# EasyEDA Pro project Dart25-有控镖航电系统.eprj, board PCB2
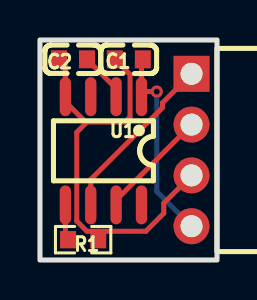
[diagram p8: board, top side]
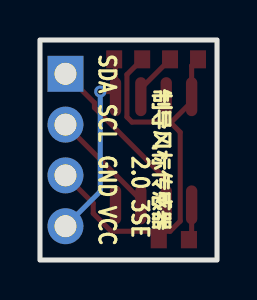
[diagram p9: board, bottom side, seen from below]

Outline 8.86 x 11 mm; copper layers: Top Layer, Bottom Layer. Coordinates in mm from the lower left corner of the outline.
Outline path: rectangle 0,11 8.86,0
Stack: Top Layer 0.035mm / Dielectric1 1.51mm FR4 er 4.5 / Bottom Layer 0.035mm

## Design rules (mm)
template: JLCPCB Capability(Two Layers Board)
spacing copperThickness1oz (default): track to track 0.102, other pairs 0.152 to 0.3
spacing copperThickness2oz: track to track 0.203, other pairs 0.152 to 0.3
track width copperThickness1oz (default): min 0.127, default 0.254, max 2.54
track width copperThickness2oz: min 0.203, default 0.254, max 2.54
differential pair differentialPair (default): width min 0.127, default 0.254, max 2.54; gap min 0.152, default 0.152
via viaSize (default): diameter min 0.5, default 0.61, max 10; hole min 0.3, default 0.305, max 6.3

## Placement (name value [footprint] x y rotation side)
C1  100nF  [C0603]  4.44 10.03 0 top
C2  1uF  [C0603]  1.65 10.03 0 top
R1  10kΩ  [R0603]  2.16 1.02 180 top
U1  AS5600-ASOM  [soic-8_l5.0-w4.0-p1.27-ls6.0-bl]  3.18 5.46 180 top
U2  HX PZ2.54-1x4P WZ  [HDR-TH_4P-P2.54-H-M-W10.3]  7.58 5.5 270 top

## Footprints (pads in the part's own frame, mm; a bottom-side part is the same pattern mirrored in y, then rotated)
C0603
  rect 0.8x0.9 smd: 1(-0.7,0) 2(0.7,0)
HDR-TH_4P-P2.54-H-M-W10.3
  rect 1.8x1.8 hole 1.1: 1(-3.81,0)
  round 1.8 hole 1.1: 2(-1.27,0) 3(1.27,0) 4(3.81,0)
R0603
  rect 0.806x0.864 smd: 1(-0.753,0) 2(0.753,0)
soic-8_l5.0-w4.0-p1.27-ls6.0-bl
  oval 0.569x1.95 smd: 1(-1.905,-2.705) 2(-0.635,-2.705) 3(0.635,-2.705) 4(1.905,-2.705) 5(1.905,2.705) 6(0.635,2.705) 7(-0.635,2.705) 8(-1.905,2.705)

## Nets
As in the schematic.

Pads without a net: U1 3 8

## Via types
v1: diameter 0.61, hole 0.305, Top Layer to Bottom Layer, 1 via

## Routing (per net, layer and track width the routed paths; a pad name or vN(x,y) marks a point on that pad's centre or on a via; arc(x,y) is an arc through that point)
GND: length 22.2
  Top Layer w0.254: 2.92,1.44 2.92,1.02 R1.1 ; 2.92,1.44 5.3,1.44 6.19,2.33 6.19,2.84 U2.3 ; 2.92,1.44 2.35,1.44 1.84,1.94 1.84,6.39 2.35,6.9 ; 2.35,6.9 2.29,6.9 1.27,7.91 U1.4 1.27,9.71 C2.1 ; 2.35,6.9 4.25,6.9 4.51,7.15 4.51,9.27 C1.1
VCC: length 10.1
  Top Layer w0.254: C1.2 5.08,9.97 5.08,8.42 ; U1.1 5.08,8.42 ; 5.08,8.42 v1(5.84,8.42)
  Bottom Layer w0.254: v1(5.84,8.42) 5.84,3.43 U2.4
SCL: length 5.6
  Top Layer w0.254: U2.2 3.81,3 U1.7
SDA: length 8.6
  Top Layer w0.254: U1.6 2.54,4.03 6.13,7.62 6.13,7.86 U2.1
$1N409: length 2.5
  Top Layer w0.254: C2.2 3.81,8.57 U1.2
$1N607: length 1.8
  Top Layer w0.254: R1.2 1.27,1.15 U1.5

## Text on the board
Bottom Silkscreen Layer: 2.0 3SE | SDA | SCL | GND | VCC | 制导风标传感器
